# EAGLE design SS_rev02 (EAGLE 6.6.0)

## Sheet 1 of 4: SS-read
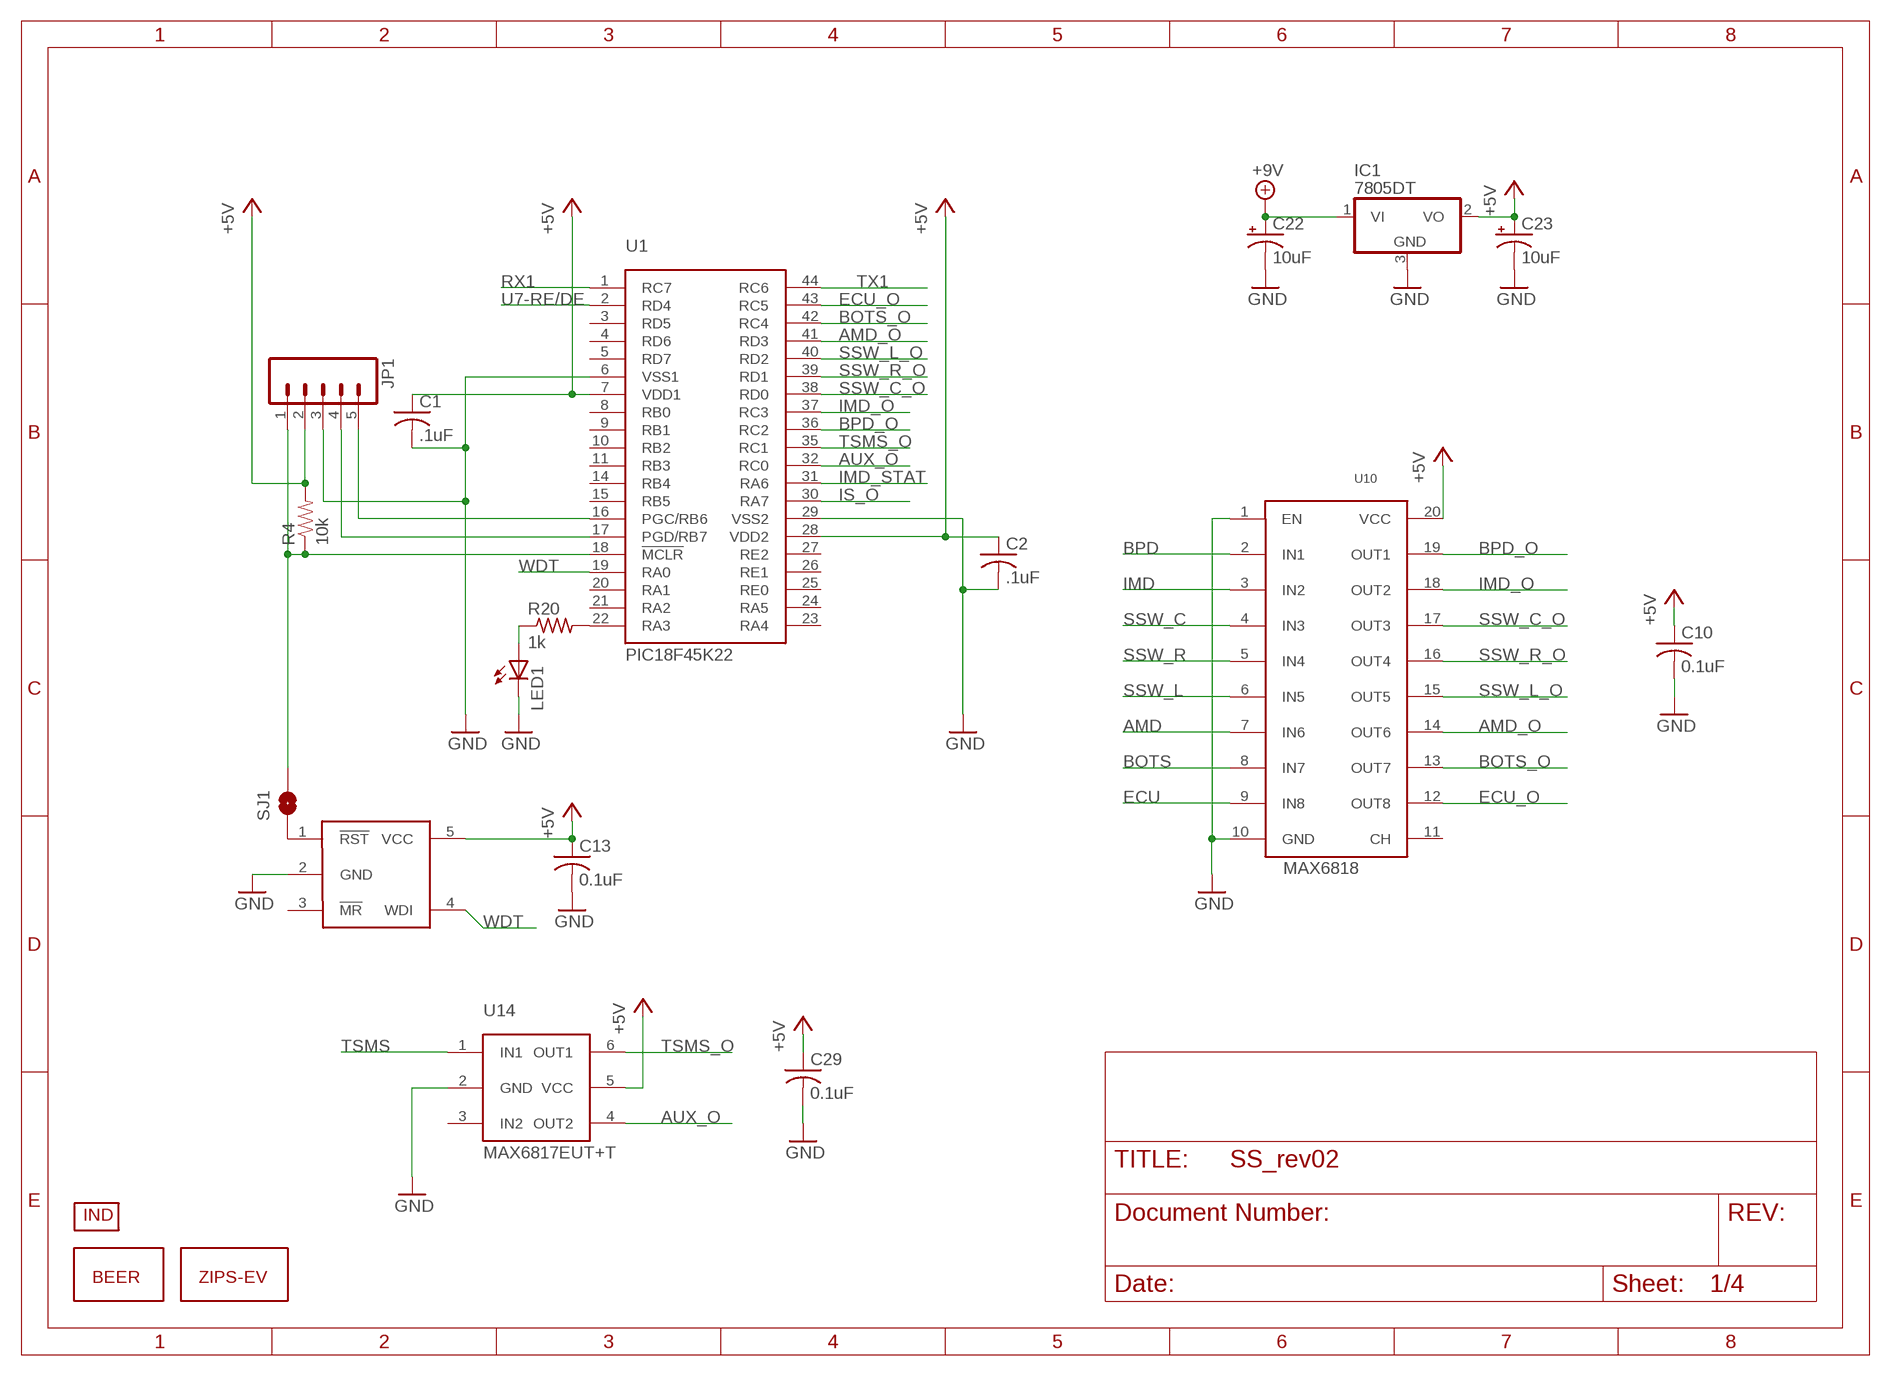
[diagram p0: schematic, sheet 1]

### Parts
C1  .1uF  C-USC0805  [C0805]
C2  .1uF  C-USC0805  [C0805]
C10  0.1uF  C-USC0805K  [C0805K]
C13  0.1uF  C-USC0805  [C0805]
C22  10uF  10UF-TANT  [EIA3216]
C23  10uF  10UF-TANT  [EIA3216]
C29  0.1uF  C-USC0805  [C0805]
IC1  7805DT  [TO252]
JP1  M05LOCK_LONGPADS  [1X05_LOCK_LONGPADS]
LED1  LEDCHIP-LED0805  [CHIP-LED0805]
R4  10k  RESISTOR0805-RES  [0805]
R20  1k  R-US_R0805  [R0805]
SJ1  SOLDERJUMPERNO  [SJ_2S-NO]
U1  PIC18F45K22  [TQFP-44]
U10  MAX6818  [SSOP-20]
U14  MAX6817EUT+T  [SOT23-6]
U15  MAX823  [SOT23-5L]
U$1  INDPK1  [PICKIT-PIN-1]
U$2  BEERM  [B-M]
U$3  LOGOM  [L-M]

### Nets
+5V: C1.1 C2.1 C10.1 C13.1 C23.A(+) C29.1 IC1.2(VO) JP1.2 R4.2 U1.7(VDD1) U1.28(VDD2) U10.20(VCC) U14.5(VCC) U15.5(VCC) ; also sheet 2,3,4
+9V: C22.A(+) IC1.1(VI) ; also sheet 4
AMD: U10.7(IN6) ; also sheet 4
AMD_O: U1.41(RD3) U10.14(OUT6)
AUX_O: U1.32(RC0) U14.4(OUT2)
BOTS: U10.8(IN7) ; also sheet 4
BOTS_O: U1.42(RC4) U10.13(OUT7)
BPD: U10.2(IN1) ; also sheet 4
BPD_O: U1.36(RC2) U10.19(OUT1)
ECU: U10.9(IN8) ; also sheet 4
ECU_O: U1.43(RC5) U10.12(OUT8)
GND: C1.2 C2.2 C10.2 C13.2 C22.C(-) C23.C(-) C29.2 IC1.3(GND) JP1.3 LED1.C U1.6(VSS1) U1.29(VSS2) U10.1(EN) U10.10(GND) U14.2(GND) U15.2(GND) ; also sheet 2,3,4
IMD: U10.3(IN2) ; also sheet 4
IMD_O: U1.37(RC3) U10.18(OUT2)
IMD_STAT: U1.31(RA6) ; also sheet 3
IS_O: U1.30(RA7) ; also sheet 4
N$1: SJ1.1 U15.1(!RST)
N$16: LED1.A R20.1
N$20: R20.2 U1.22(RA3)
N$40: JP1.4 U1.17(PGD/RB7)
N$43: JP1.5 U1.16(PGC/RB6)
N$46: JP1.1 R4.1 SJ1.2 U1.18(!MCLR)
RX1: U1.1(RC7) ; also sheet 4
SSW_C: U10.4(IN3) ; also sheet 4
SSW_C_O: U1.38(RD0) U10.17(OUT3)
SSW_L: U10.6(IN5) ; also sheet 4
SSW_L_O: U1.40(RD2) U10.15(OUT5)
SSW_R: U10.5(IN4) ; also sheet 4
SSW_R_O: U1.39(RD1) U10.16(OUT4)
TSMS: U14.1(IN1) ; also sheet 4
TSMS_O: U1.35(RC1) U14.6(OUT1)
TX1: U1.44(RC6) ; also sheet 4
U7-RE/DE: U1.2(RD4) ; also sheet 4
WDT: U1.19(RA0) U15.4(WDI)
Unconnected: U1.3(RD5) U1.4(RD6) U1.5(RD7) U1.8(RB0) U1.9(RB1) U1.10(RB2) U1.11(RB3) U1.14(RB4) U1.15(RB5) U1.20(RA1) U1.21(RA2) U1.23(RA4) U1.24(RA5) U1.25(RE0) U1.26(RE1) U1.27(RE2) U10.11(CH) U14.3(IN2) U15.3(!MR)

## Sheet 2 of 4: PRE charge
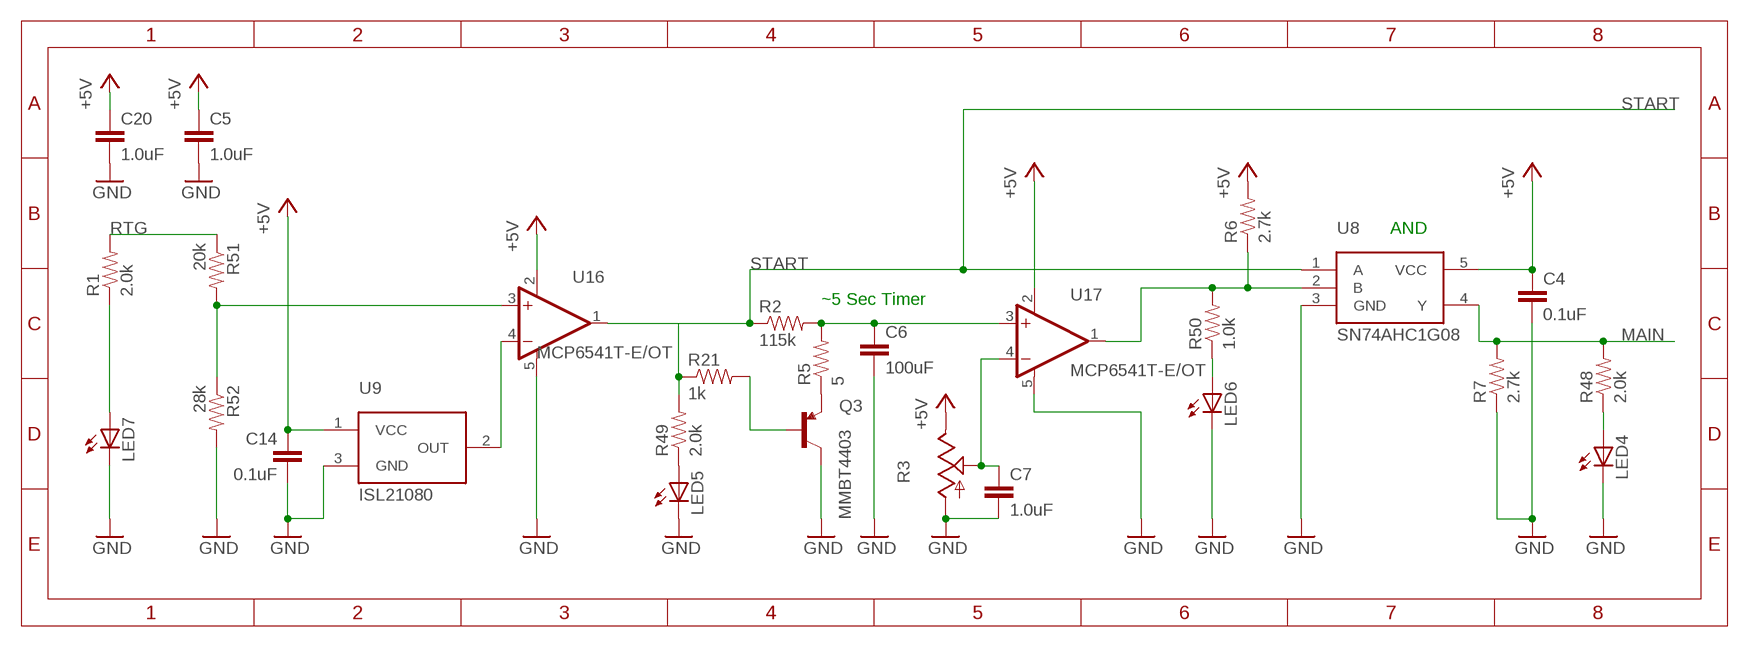
[diagram p1: schematic, sheet 2]

### Parts
C4  0.1uF  CAP0805  [0805]
C5  1.0uF  CAP0805  [0805]
C6  100uF  CAP1206  [1206]
C7  1.0uF  CAP0805  [0805]
C14  0.1uF  CAP0805  [0805]
C20  1.0uF  CAP0805  [0805]
LED4  LEDCHIPLED_0805  [CHIPLED_0805]
LED5  LEDCHIPLED_0805  [CHIPLED_0805]
LED6  LEDCHIPLED_0805  [CHIPLED_0805]
LED7  LEDCHIPLED_0805  [CHIPLED_0805]
Q3  MMBT4403  TRANSISTOR_PNPMMBT4403  [SOT23]
R1  2.0k  RESISTOR0805-RES  [0805]
R2  115k  RESISTOR1206  [1206]
R3  TRIM_US-CA6H  [CA6H]
R5  5  RESISTOR0805-RES  [0805]
R6  2.7k  RESISTOR0805-RES  [0805]
R7  2.7k  RESISTOR0805-RES  [0805]
R21  1k  RESISTOR0805-RES  [0805]
R48  2.0k  RESISTOR0805-RES  [0805]
R49  2.0k  RESISTOR0805-RES  [0805]
R50  1.0k  RESISTOR0805-RES  [0805]
R51  20k  RESISTOR0805-RES  [0805]
R52  28k  RESISTOR0805-RES  [0805]
U8  SN74AHC1G08  NC7SZ08P5X  [SOT23-5]
U9  ISL21080  [SOT-23]
U16  MCP6541T-E/OT  OPA344  [SOT23-5]
U17  MCP6541T-E/OT  OPA344  [SOT23-5]

### Nets
+5V: C4.1 C5.1 C14.1 C20.1 R3.E R6.2 U8.5(VCC) U9.1(VCC) U16.2(V-) U17.2(V-) ; also sheet 1,3,4
GND: C4.2 C5.2 C6.2 C7.2 C14.2 C20.2 LED4.C LED5.C LED6.C LED7.C Q3.3(C) R3.A R7.1 R52.2 U8.3(GND) U9.3(GND) U16.5(V+) U17.5(V+) ; also sheet 1,3,4
MAIN: R7.2 R48.2 U8.4(Y) ; also sheet 4
N$5: Q3.1(B) R21.2
N$6: Q3.2(E) R5.1
N$8: C7.1 R3.S U17.4(-IN)
N$11: U9.2(OUT) U16.4(-IN)
N$12: R51.2 R52.1 U16.3(+IN)
N$33: LED7.A R1.1
N$59: C6.1 R2.2 R5.2 U17.3(+IN)
N$62: R6.1 R50.2 U8.2(B) U17.1(OUT)
N$63: LED4.A R48.1
N$65: LED5.A R49.1
N$67: LED6.A R50.1
RTG: R1.2 R51.1 ; also sheet 4
START: R2.1 R21.1 R49.2 U8.1(A) U16.1(OUT) ; also sheet 4

### Notes on the sheet
- AND
- ~5 Sec Timer

## Sheet 3 of 4
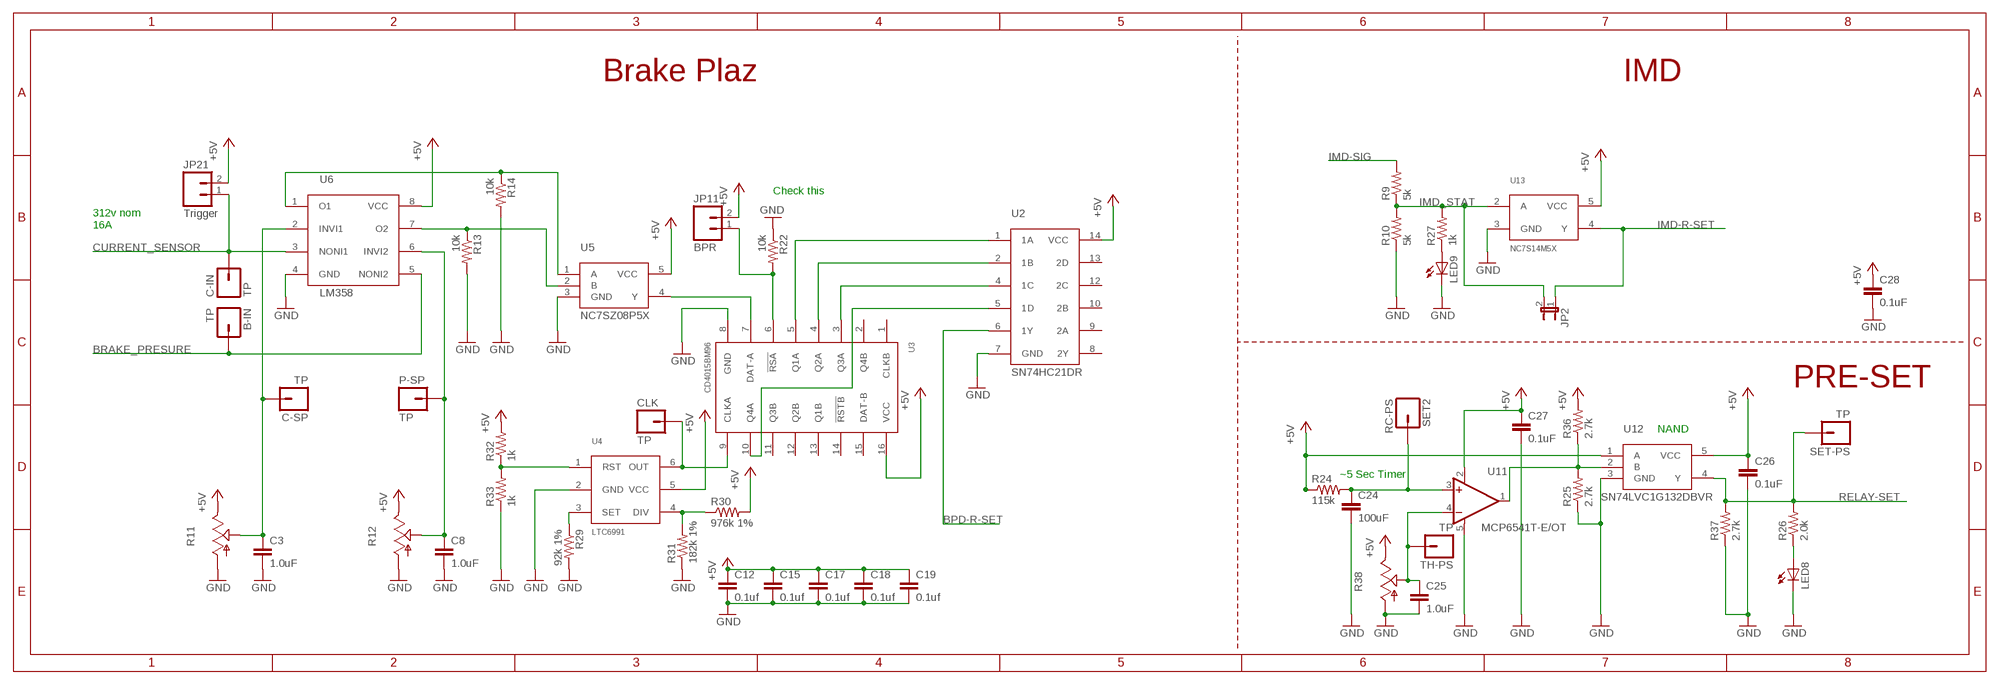
[diagram p2: schematic, sheet 3]

### Parts
B-IN  TP  M01PTH  [1X01]
C3  1.0uF  1.0UF-25V-+80/-20(0805)  [0805]
C8  1.0uF  1.0UF-25V-+80/-20(0805)  [0805]
C12  0.1uf  CAP0805  [0805]
C15  0.1uf  CAP0805  [0805]
C17  0.1uf  CAP0805  [0805]
C18  0.1uf  CAP0805  [0805]
C19  0.1uf  CAP0805  [0805]
C24  100uF  CAP1206  [1206]
C25  1.0uF  CAP0805  [0805]
C26  0.1uF  CAP0805  [0805]
C27  0.1uF  CAP0805  [0805]
C28  0.1uF  CAP0805  [0805]
C-IN  TP  M01PTH  [1X01]
C-SP  TP  M01PTH  [1X01]
CLK  TP  M01PTH  [1X01]
JP2  JUMPER-2SMD-NO  [SJ_2S-NO]
JP11  BPR  M02POLAR_LOCK  [MOLEX-1X2_LOCK]
JP21  Trigger  M02POLAR_LOCK  [MOLEX-1X2_LOCK]
LED8  LEDCHIPLED_0805  [CHIPLED_0805]
LED9  LEDCHIPLED_0805  [CHIPLED_0805]
P-SP  TP  M01PTH  [1X01]
R9  5k  RESISTOR0805-RES  [0805]
R10  5k  RESISTOR0805-RES  [0805]
R11  TRIM_US-CA6H  [CA6H]
R12  TRIM_US-CA6H  [CA6H]
R13  10k  RESISTOR0805-RES  [0805]
R14  10k  RESISTOR0805-RES  [0805]
R22  10k  RESISTOR0805-RES  [0805]
R24  115k  RESISTOR1206  [1206]
R25  2.7k  RESISTOR0805-RES  [0805]
R26  2.0k  RESISTOR0805-RES  [0805]
R27  1k  RESISTOR0805-RES  [0805]
R29  92k 1%  RESISTOR0805-RES  [0805]
R30  976k 1%  RESISTOR0805-RES  [0805]
R31  182k 1%  RESISTOR0805-RES  [0805]
R32  1k  RESISTOR0805-RES  [0805]
R33  1k  RESISTOR0805-RES  [0805]
R36  2.7k  RESISTOR0805-RES  [0805]
R37  2.7k  RESISTOR0805-RES  [0805]
R38  TRIM_US-CA6H  [CA6H]
SET2  RC-PS  M01PTH  [1X01]
SET-PS  TP  M01PTH  [1X01]
TH-PS  TP  M01PTH  [1X01]
U2  SN74HC21DR  SN74HC20DR  [SO14]
U3  CD4015BM96  [SO-16]
U4  LTC6991  [TSOT-23-6]
U5  NC7SZ08P5X  [SOT23-5]
U6  LM358  [TSSOP-8]
U11  MCP6541T-E/OT  OPA344  [SOT23-5]
U12  SN74LVC1G132DBVR  NC7SZ08P5X  [SOT23-5]
U13  NC7S14M5X  [SOT23-5]

### Nets
+5V: C12.1 C15.1 C17.1 C18.1 C19.1 C26.1 C27.1 C28.1 JP11.2 JP21.2 R11.E R12.E R24.1 R30.2 R32.2 R36.2 R38.E U2.14(VCC) U3.16(VCC) U4.5(VCC) U5.5(VCC) U6.8(VCC) U11.2(V-) U12.1(A) U12.5(VCC) U13.5(VCC) ; also sheet 1,2,4
BPD-R-SET: U2.6(1Y) ; also sheet 4
BRAKE_PRESURE: B-IN.1 U6.5(NONI2) ; also sheet 4
CURRENT_SENSOR: C-IN.1 JP21.1 U6.3(NONI1) ; also sheet 4
GND: C3.2 C8.2 C12.2 C15.2 C17.2 C18.2 C19.2 C24.2 C25.2 C26.2 C27.2 C28.2 LED8.C LED9.C R10.1 R11.A R12.A R13.2 R14.2 R22.1 R25.1 R29.2 R31.1 R33.1 R37.1 R38.A U2.7(GND) U3.8(GND) U4.2(GND) U5.3(GND) U6.4(GND) U11.5(V+) U12.3(GND) U13.3(GND) ; also sheet 1,2,4
IMD-R-SET: JP2.1 U13.4(Y) ; also sheet 4
IMD-SIG: R9.2 ; also sheet 4
IMD_STAT: JP2.2 R9.1 R10.2 R27.2 U13.2(A) ; also sheet 1
N$4: C25.1 R38.S TH-PS.1 U11.4(-IN)
N$7: U2.5(1D) U3.10(Q4A)
N$10: R30.1 R31.2 U4.4(DIV)
N$13: U3.7(DAT-A) U5.4(Y)
N$14: JP11.1 R22.2 U3.6(!RSA)
N$15: C24.1 R24.2 SET2.1 U11.3(+IN)
N$17: U2.1(1A) U3.5(Q1A)
N$18: U2.2(1B) U3.4(Q2A)
N$19: U2.4(1C) U3.3(Q3A)
N$21: R29.1 U4.3(SET)
N$22: CLK.1 U3.9(CLKA) U4.6(OUT)
N$23: C8.1 P-SP.1 R12.S U6.6(INVI2)
N$24: R25.2 R36.1 U11.1(OUT) U12.2(B)
N$25: R32.1 R33.2 U4.1(RST)
N$26: C3.1 C-SP.1 R11.S U6.2(INVI1)
N$28: R14.1 U5.1(A) U6.1(O1)
N$29: LED8.A R26.1
N$30: R13.1 U5.2(B) U6.7(O2)
N$32: LED9.A R27.1
RELAY-SET: R26.2 R37.2 SET-PS.1 U12.4(Y) ; also sheet 4
Unconnected: U2.8(2Y) U2.9(2A) U2.10(2B) U2.12(2C) U2.13(2D) U3.1(CLKB) U3.2(Q4B) U3.11(Q3B) U3.12(Q2B) U3.13(Q1B) U3.14(!RSTB) U3.15(DAT-B)

### Notes on the sheet
- Brake Plaz | IMD
- Check this
- 312v nom
  16A
- PRE-SET
- NAND
- ~5 Sec Timer

## Sheet 4 of 4
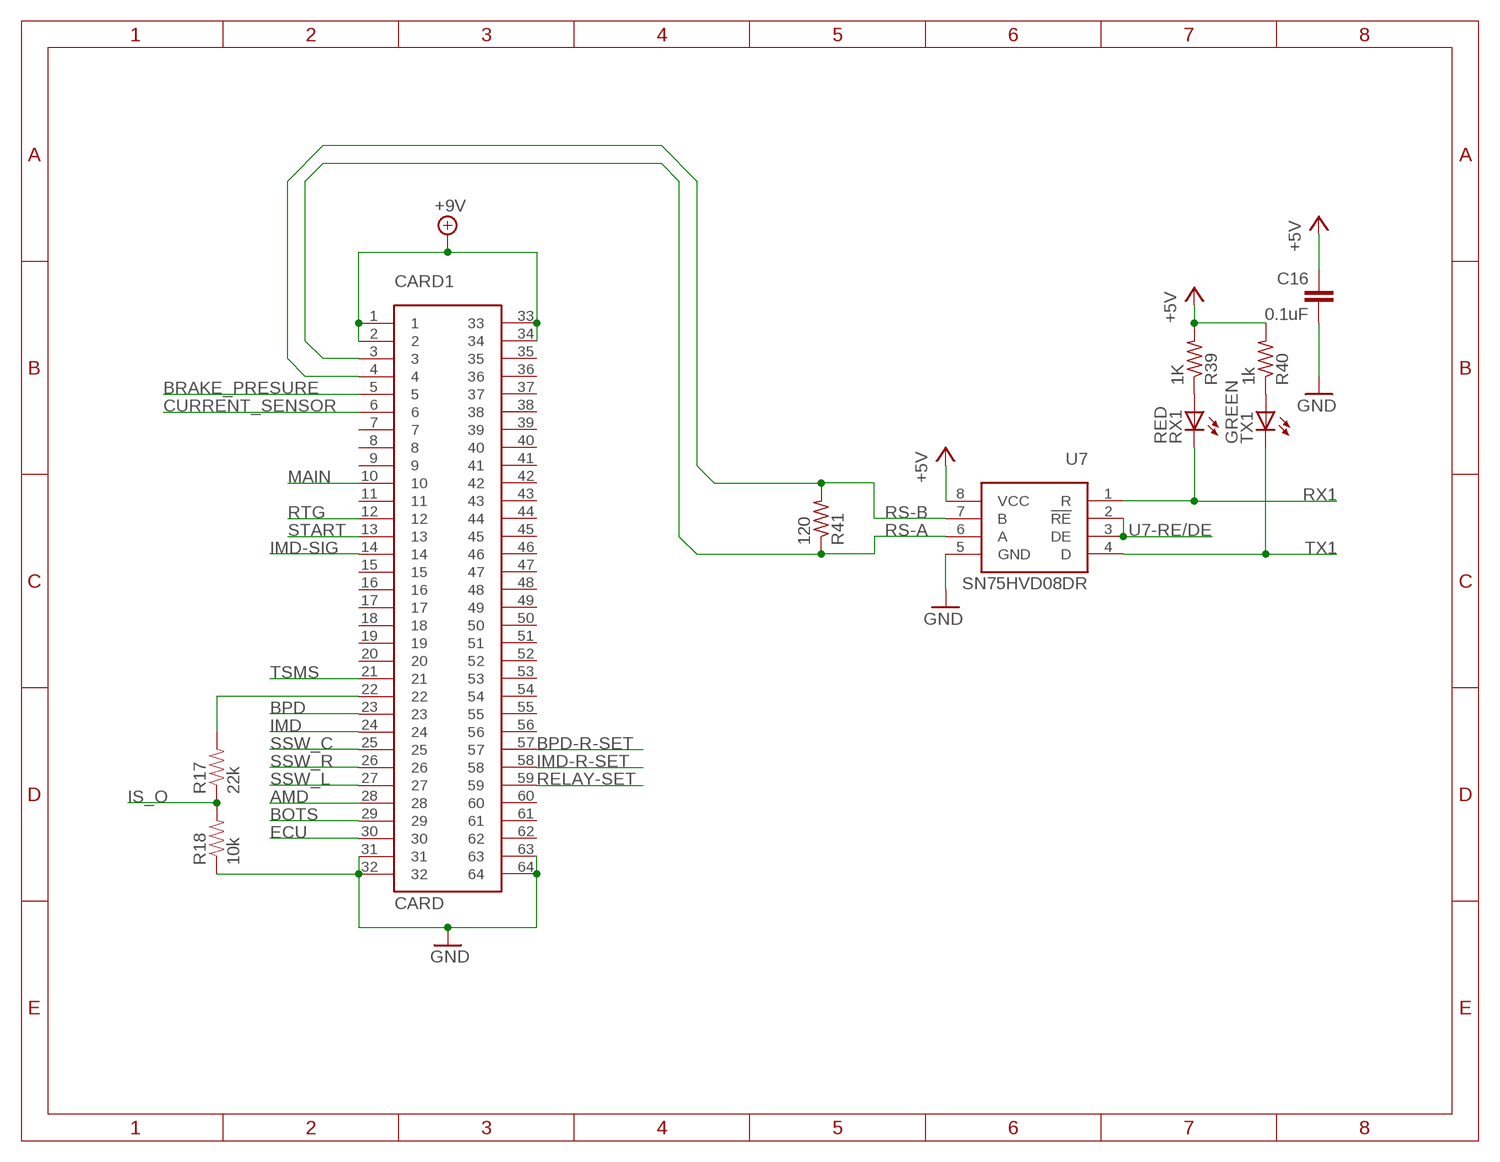
[diagram p3: schematic, sheet 4]

### Parts
C16  0.1uF  CAP0805  [0805]
CARD1  CARD  [CARD-64]
R17  22k  RESISTOR0805-RES  [0805]
R18  10k  RESISTOR0805-RES  [0805]
R39  1K  R-US_R0805  [R0805]
R40  1k  R-US_R0805  [R0805]
R41  120  R-US_R0805  [R0805]
RX1  RED  LEDCHIPLED_0805  [CHIPLED_0805]
TX1  GREEN  LEDCHIPLED_0805  [CHIPLED_0805]
U7  SN75HVD08DR  [SO-8]

### Nets
+5V: C16.1 R39.2 R40.2 U7.8(VCC) ; also sheet 1,2,3
+9V: CARD1.1 CARD1.2 CARD1.33 CARD1.34 ; also sheet 1
AMD: CARD1.28 ; also sheet 1
BOTS: CARD1.29 ; also sheet 1
BPD: CARD1.23 ; also sheet 1
BPD-R-SET: CARD1.57 ; also sheet 3
BRAKE_PRESURE: CARD1.5 ; also sheet 3
CURRENT_SENSOR: CARD1.6 ; also sheet 3
ECU: CARD1.30 ; also sheet 1
GND: C16.2 CARD1.31 CARD1.32 CARD1.63 CARD1.64 R18.1 U7.5(GND) ; also sheet 1,2,3
IMD: CARD1.24 ; also sheet 1
IMD-R-SET: CARD1.58 ; also sheet 3
IMD-SIG: CARD1.14 ; also sheet 3
IS_O: R17.1 R18.2 ; also sheet 1
MAIN: CARD1.10 ; also sheet 2
N$2: CARD1.22 R17.2
N$39: R40.1 TX1.A
N$41: R39.1 RX1.A
RELAY-SET: CARD1.59 ; also sheet 3
RS-A: CARD1.3 R41.1 U7.6(A)
RS-B: CARD1.4 R41.2 U7.7(B)
RTG: CARD1.12 ; also sheet 2
RX1: RX1.C U7.1(R) ; also sheet 1
SSW_C: CARD1.25 ; also sheet 1
SSW_L: CARD1.27 ; also sheet 1
SSW_R: CARD1.26 ; also sheet 1
START: CARD1.13 ; also sheet 2
TSMS: CARD1.21 ; also sheet 1
TX1: TX1.C U7.4(D) ; also sheet 1
U7-RE/DE: U7.2(!RE) U7.3(DE) ; also sheet 1
Unconnected: CARD1.7 CARD1.8 CARD1.9 CARD1.11 CARD1.15 CARD1.16 CARD1.17 CARD1.18 CARD1.19 CARD1.20 CARD1.35 CARD1.36 CARD1.37 CARD1.38 CARD1.39 CARD1.40 CARD1.41 CARD1.42 CARD1.43 CARD1.44 CARD1.45 CARD1.46 CARD1.47 CARD1.48 CARD1.49 CARD1.50 CARD1.51 CARD1.52 CARD1.53 CARD1.54 CARD1.55 CARD1.56 CARD1.60 CARD1.61 CARD1.62

## Library data of the parts
B-IN C-IN C-SP CLK P-SP SET2 SET-PS TH-PS = SparkFun-Connectors:M01: Header 1 Standard 1-pin 0.1" header. Use with straight break away headers (SKU : PRT-00116), right angle break away headers (PRT-00553), swiss pins (PRT-00743), machine pins (PRT-00117), and female headers (PRT-00115).
C1 C2 C10 C13 C29 = adafruit:C-US: CAPACITOR, American symbol
C3 C8 = SparkFun-Capacitors:1.0UF-25V-+80/-20(0805); PROD_ID: CAP-11625
C4 C5 C7 C12 C14-C20 C25-C28 = SparkFun-Passives:CAP: Capacitor Standard 0603 ceramic capacitor, and 0.1" leaded capacitor.
C6 C24 = SparkFun-Capacitors:CAP: Capacitor Standard 0603 ceramic capacitor, and 0.1" leaded capacitor.
C22 C23 = SparkFun-Capacitors:10UF-TANT: 10uF Tantalum SMT CAP-00811- 16V 10% (EIA-3216); PROD_ID: CAP-00811
CARD1 = FSAE Eletric:CARD
IC1 = adafruit:78*: Positive VOLTAGE REGULATOR Added bigger pads to the TO-92 package
JP1 = SparkFun-Connectors:M05: Header 5 Standard 5-pin 0.1" header. Use with straight break away headers (SKU : PRT-00116), right angle break away headers (PRT-00553), swiss pins (PRT-00743), machine pins (PRT-00117), and female headers (PRT-00115). Molex polarized connector foot print use with SKU : PRT-08230 with associated crimp pins and housings.
JP2 = SparkFun-Passives:JUMPER-2: Jumper Basic 0.1" spaced jumper. Use with breakaway headers.
JP11 JP21 = SparkFun-Connectors:M02: Standard 2-pin 0.1" header. Use with - straight break away headers ( PRT-00116) - right angle break away headers (PRT-00553) - swiss pins (PRT-00743) - machine pins (PRT-00117) - female headers (PRT-00115) Molex polarized connector foot print use with: PRT-08233 with associated crimp pins and housings. 2.54_SCREWTERM for use with PRT-10571. 3.5mm Screw Terminal footprints for PRT-08084 5mm Screw Terminal footprints for use with PRT-08433
LED1 LED4-LED9 RX1 TX1 = adafruit:LED: LED OSRAM: - CHIPLED LG R971, LG N971, LY N971, LG Q971, LY Q971, LO R971, LY R971 LH N974, LH R974 LS Q976, LO Q976, LY Q976 LO Q996 - Hyper CHIPLED LW Q18S LB Q993, LB Q99A, LB R99A - SideLED LS A670, LO A670, LY A670, LG A670, LP A670 LB A673, LV A673, LT A673, LW A673 LH A674 LY A675 LS A676, LA A676, LO A676, LY A676, LW A676 LS A679, LY A679, LG A679 - Hyper Micro SIDELED® LS Y876, LA Y876, LO Y876, LY Y876 LT Y87S - SmartLED LW L88C, LW L88S LB L89C, LB L89S, LG L890 LS L89K, LO L89K, LY L89K LS L896, LA L896, LO L896, LY L896 - TOPLED LS T670, LO T670, LY T670, LG T670, LP T670 LSG T670, LSP T670, LSY T670, LOP T670, LYG T670 LG T671, LOG T671, LSG T671 LB T673, LV T673, LT T673, LW T673 LH T674 LS T676, LA T676, LO T676, LY T676, LB T676, LH T676, LSB T676, LW T676 LB T67C, LV T67C, LT T67C, LS T67K, LO T67K, LY T67K, LW E67C LS E67B, LA E67B, LO E67B, LY E67B, LB E67C, LV E67C, LT E67C LW T67C LS T679, LY T679, LG T679 LS T770, LO T770, LY T770, LG T770, LP T770 LB T773, LV T773, LT T773, LW T773 LH T774 LS E675, LA E675, LY E675, LS T675 LS T776, LA T776, LO T776, LY T776, LB T776 LHGB T686 LT T68C, LB T68C - Hyper Mini TOPLED® LB M676 - Mini TOPLED Santana® LG M470 LS M47K, LO M47K, LY M47K Source: http://www.osram.convergy.de/
Q3 = SparkFun-DiscreteSemi:TRANSISTOR_PNP: Generic PNP BJT Double check pinouts against datasheets- not all devices are the same! MMBT3906 - 40V 200mA SOT-23 (TRANS-08052) MMBT4403 - 40V 600mA SOT-23 (TRANS-09245); PROD_ID: TRANS-09245
R1 R4-R7 R9 R10 R17 R18 R21 R25-R27 R36 R37 R48-R50 = SparkFun-Passives:RESISTOR: Resistor Basic schematic elements and footprints for 0603, 1206, and PTH resistors.
R2 R13 R14 R22 R24 R29-R33 R51 R52 = SparkFun-Resistors:RESISTOR: Resistor Basic schematic elements and footprints for 0603, 1206, and PTH resistors.
R3 R11 R12 R38 = pot:TRIM_US-: POTENTIOMETER
R20 R39-R41 = adafruit:R-US_: RESISTOR, American symbol
SJ1 = SparkFun-Passives:SOLDERJUMPER: Solder Jumper Standard SMD solder jumper. Used to automate production. Two varients : Normally Open and Normally Closed are the same, but have different paste layers. NC will have a large amount of paste and should jumper during reflow.
U1 = FSAE Eletric:PIC18F45K22
U2 = NASA_LIB:SN74HC20DR
U3 = FSAE Eletric:CD4015BM96
U4 = FSAE Eletric:LTC6991
U5 U8 U12 = FSAE Eletric:NC7SZ08P5X
U6 = NASA_LIB:LM358
U7 = FSAE Eletric:SN75HVD08DR
U9 = DFT2:ISL21080
U10 = NASA_LIB:MAX6818
U11 U16 U17 = SparkFun-AnalogIC:OPA344: Single gate rail-to-rail output op-amp. Inputs extend 300mV past rails.
U13 = FSAE Eletric:NC7S14M5X
U14 = NASA_LIB:MAX6817EUT+T
U15 = NASA_LIB:MAX823
U$1 = FSAE Eletric (2):IND
U$2 = Pic:BEER
U$3 = Pic:LOGO

## Board